# EasyEDA Pro project cubicat_pcb.eprj, board PCB_audio_sdcard
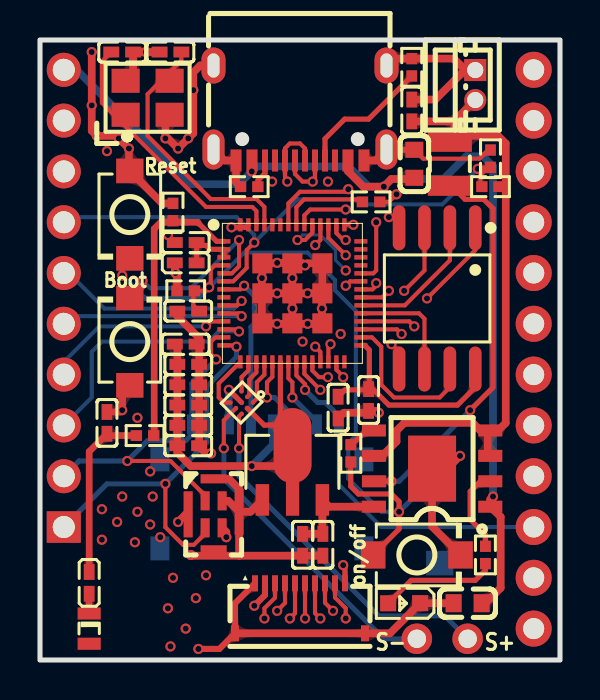
[diagram p13: board, top side]
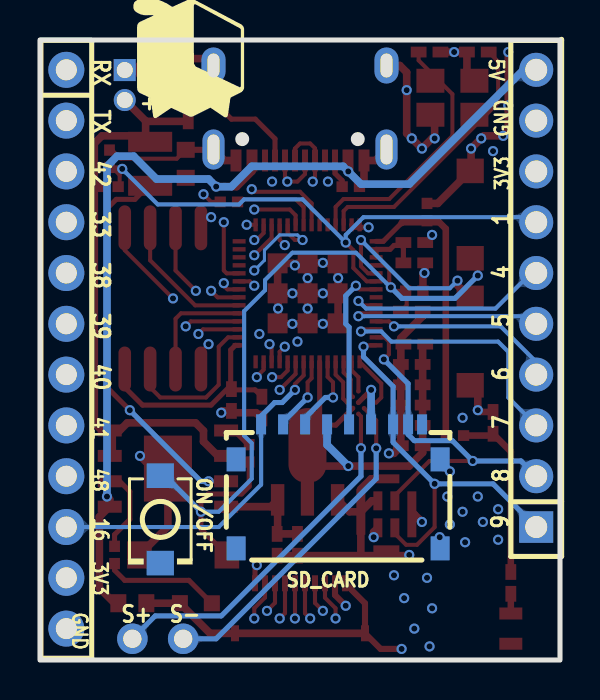
[diagram p14: board, bottom side, seen from below]

Outline 26 x 31 mm; copper layers: Top Layer, GND, PWR, Bottom Layer. Coordinates in mm from the lower left corner of the outline.
Outline path: rectangle 0,31 26,0
Stack: Top Layer 0.035mm 外层铜厚1oz / Dielectric1 0.2104mm 7628 RC49% 8.6mil / GND 0.0152mm 内层铜厚 / Dielectric2 1.065mm 1.1mm H/HOZ 含铜 / PWR 0.0152mm 内层铜厚 / Dielectric3 0.2104mm 7628 RC49% 8.6mil / Bottom Layer 0.035mm 外层铜厚1oz

## Design rules (mm)
net D-: USB-OTG
net D+: USB-OTG
template: 自定义配置
spacing copperThickness1oz (default): track to track 0.102, other pairs 0.152 to 0.3
spacing copperThickness2oz: track to track 0.203, other pairs 0.152 to 0.3
track width copperThickness1oz (default): min 0.127, default 0.254, max 2.54
track width copperThickness2oz: min 0.203, default 0.254, max 2.54
differential pair 90ohm (default): width min 0.203, default 0.203, max 0.229; gap min 0.152, default 0.203
via viaSize (default): diameter min 0.5, default 0.508, max 10; hole min 0.3, default 0.305, max 6.299

## Placement (name value [footprint] x y rotation side)
ANT1  KH-1608-H08  [ANT-SMD_L1.7-W0.9]  2.46 1.57 90 top
BAT1  A1501WV-2P  [CONN-TH_A1501WV-2P]  21.76 28.75 270 top
Boot  TS-1088-AR02016  [SW-SMD_L3.9-W3.0-P4.45]  4.49 15.92 90 top
C4  10uF  [C0402]  18.59 27.48 90 top
C6  10uF  [C0402]  14.14 5.76 270 top
C7  10uF  [C0603]  21.38 2.84 0 top
C8  10uF  [C0603]  18.72 24.81 270 top
C9  10uF  [C0402]  13.13 5.76 270 top
C13  10uF  [C0402]  7.41 11.73 180 top
C14  100nF  [C0402]  7.41 10.71 180 top
C15  1uF  [C0402]  7.41 17.44 0 top
C16  10uF  [C0402]  7.41 13.76 180 top
C17  1uF  [C0402]  7.28 15.79 180 top
C18  100nF  [C0402]  7.28 20.87 0 top
C20  15pF  [C0402]  4.11 30.4 0 top
C21  15pF  [C0402]  6.52 30.4 0 top
C22  1uF  [C0402]  7.41 12.75 180 top
C23  100nF  [C0402]  16.43 13 90 top
C24  1uF  [C0402]  14.91 12.62 90 top
C25  1.5pF  [C0402]  3.35 11.86 270 top
C30  10uF  [C0402]  7.41 14.78 180 top
ESP32S3R8  -  [esp32s3R8]  12.62 18.33 0 top
FPC2  HC-FPC-05-09-10RLTAG  [FPC-SMD_10P-P0.50_HC-FPC-05-09-10RLTAG]  13 2.58 180 top
L1  2.2uH  [IND-SMD_L2.5-W2.0_MHCHL2520]  20.49 24.81 90 top
L2  2nH  [L0402]  7.28 19.86 0 top
L3  5.6nH  [L0402]  2.46 3.86 90 top
LED1  19-213/Y2C-CQ2R2L/3T(CY)  [LED0603-RD-YELLOW]  18.21 2.84 180 top
MIC1  LMD4030T261-OA1  [MIC-SMD_8P-L4.0-W3.0]  8.68 7.28 0 top
NOREF  -  [Pad_e32]  18.84 1.06 0 top
NOREF#2  -  [Pad_e34]  21.38 1.06 0 top
on/off  TS-1088-AR02016  [SW-SMD_L3.9-W3.0-P4.45]  18.84 5.25 0 top
ON/OFF  TS-1088-AR02016  [SW-SMD_L3.9-W3.0-P4.45]  19.99 7.03 270 bottom
Q1  AMS1117-3.3  [SOT-89_L4.5-W2.5-P1.50-LS4.2-BR]  12.62 9.36 270 top
R5  200Ω  [R0402]  22.27 5.25 90 top
R7  10kΩ  [R0402]  7.28 18.46 180 top
R9  5.1kΩ  [R0402]  10.46 23.67 0 top
R10  5.1kΩ  [R0402]  18.59 29.64 90 top
R11  10kΩ  [R0402]  15.54 10.33 270 top
R14  0Ω  [R0402]  5.25 11.22 0 top
R15  0Ω  [R0402]  6.65 22.4 270 top
R20  51kΩ  [R0402]  22.53 23.67 0 top
R22  470Ω  [R0402]  16.56 22.91 0 top
R24  15kΩ  [R0402]  22.53 25.06 270 top
Reset  TS-1088-AR02016  [SW-SMD_L3.9-W3.0-P4.45]  4.49 22.27 270 top
SD_CARD  TF-018  [TF-SMD_TF-018]  11.09 8.68 0 bottom
U6  IP5305T  [ESOP-8_L4.9-W3.9-P1.27-LS6.0-BL-EP]  19.6 9.57 90 top
U25  MAX98357AEWL+T  [WLP-9_L1.4-W1.3-P0.40-R3-C3-BR]  10.08 12.87 45 top
U32  W25Q128JVSIQ  [SOIC-8_L5.3-W5.3-P1.27-LS8.0-BL]  19.86 18.08 180 top
U34  PM254-1-12-Z-8.5  [HDR-TH_12P-P2.54-V-F]  24.68 15.54 270 bottom
U35  PM254-1-10-Z-8.5  [hdr-th_10p-p2.54-v-f]  1.19 18.08 90 bottom
USB1  TYPE-C 16PIN 2MD(073)  [USB-C-SMD_TYPE-C-6PIN-2MD-073]  13 27.35 180 top
X1  40MHz  [osc-smd_4p-l3.2-w2.5-bl_sit8008bi]  5.38 28.11 0 top

## Footprints (pads in the part's own frame, mm; a bottom-side part is the same pattern mirrored in y, then rotated)
ANT-SMD_L1.7-W0.9
  rect 0.6x1.15 smd: 1(-0.756,0) 2(0.756,0)
C0402
  rect 0.79x0.54 smd: 1(-0.545,0) 2(0.545,0)
C0603
  rect 0.8x0.9 smd: 1(-0.7,0) 2(0.7,0)
CONN-TH_A1501WV-2P
  rect 1.1x1.1 hole 0.8: 1(-0.75,0)
  round 1.1 hole 0.8: 2(0.75,0)
ESOP-8_L4.9-W3.9-P1.27-LS6.0-BL-EP
  rect 0.6x1.2 smd: 1(-1.905,-2.909) 2(-0.635,-2.909) 3(0.635,-2.909) 4(1.905,-2.909) 5(1.905,2.909) 6(0.635,2.909) 7(-0.635,2.909) 8(-1.905,2.909)
  rect 3.3x2.4 smd: 9(0,0)
esp32s3R8
  rect 0.65x0.22 smd: 1(-3.425,2.6) 2(-3.425,2.2) 3(-3.425,1.8) 4(-3.425,1.4) 5(-3.425,1) 6(-3.425,0.6) 7(-3.425,0.2) 8(-3.425,-0.2) 9(-3.425,-0.6) 10(-3.425,-1) 11(-3.425,-1.4) 12(-3.425,-1.8) 13(-3.425,-2.2) 14(-3.425,-2.6) 29(3.425,-2.6) 30(3.425,-2.2) 31(3.425,-1.8) 32(3.425,-1.4) 33(3.425,-1) 34(3.425,-0.6) 35(3.425,-0.2) 36(3.425,0.2) 37(3.425,0.6) 38(3.425,1) 39(3.425,1.4) 40(3.425,1.8) 41(3.425,2.2) 42(3.425,2.6)
  rect 0.22x0.65 smd: 15(-2.6,-3.425) 16(-2.2,-3.425) 17(-1.8,-3.425) 18(-1.4,-3.425) 19(-1,-3.425) 20(-0.6,-3.425) 21(-0.2,-3.425) 22(0.2,-3.425) 23(0.6,-3.425) 24(1,-3.425) 25(1.4,-3.425) 26(1.8,-3.425) 27(2.2,-3.425) 28(2.6,-3.425) 43(2.6,3.425) 44(2.2,3.425) 45(1.8,3.425) 46(1.4,3.425) 47(1,3.425) 48(0.6,3.425) 49(0.2,3.425) 50(-0.2,3.425) 51(-0.6,3.425) 52(-1,3.425) 53(-1.4,3.425) 54(-1.8,3.425) 55(-2.2,3.425) 56(-2.6,3.425)
  rect 1x1 smd: 57(-1.5,1.5) 57(-1.5,0) 57(-1.5,-1.5) 57(0,1.5) 57(0,0) 57(0,-1.5) 57(1.5,1.5) 57(1.5,0) 57(1.5,-1.5)
FPC-SMD_10P-P0.50_HC-FPC-05-09-10RLTAG
  rect 0.3x0.8 smd: 1(2.25,-1.25) 2(1.75,-1.25) 3(1.25,-1.25) 4(0.75,-1.25) 5(0.25,-1.25) 6(-0.25,-1.25) 7(-0.75,-1.25) 8(-1.25,-1.25) 9(-1.75,-1.25) 10(-2.25,-1.25)
  rect 0.4x0.8 smd: 11(-3.25,1.25) 12(3.25,1.25)
hdr-th_10p-p2.54-v-f
  rect 1.575x1.7 hole 1.1: 1(-11.43,0)
  round 1.7 hole 1.1: 2(-8.89,0) 3(-6.35,0) 4(-3.81,0) 5(-1.27,0) 6(1.27,0) 7(3.81,0) 8(6.35,0) 9(8.89,0) 10(11.43,0)
HDR-TH_12P-P2.54-V-F
  round 1.8 hole 1.05: 1(-13.97,0) 2(-11.43,0) 3(-8.89,0) 4(-6.35,0) 5(-3.81,0) 6(-1.27,0) 7(1.27,0) 8(3.81,0) 9(6.35,0) 10(8.89,0) 11(11.43,0) 12(13.97,0)
IND-SMD_L2.5-W2.0_MHCHL2520
  rect 1x2.2 smd: 1(-1.1,0) 2(1.1,0)
L0402
  rect 0.79x0.54 smd: 1(-0.545,0) 2(0.545,0)
LED0603-RD-YELLOW
  rect 0.8x0.8 smd: 1(-0.799,-0.004) 2(0.799,0.004)
MIC-SMD_8P-L4.0-W3.0
  rect 0.45x0.95 smd: 1(-0.425,0.675) 2(-0.425,-0.675) 3(0.425,-0.675) 4(0.425,0.675)
  rect 0.45x2.3 smd: 5(1.275,0.127) 7(-1.275,0)
  rect 1.3x0.45 smd: 6(0,-1.775) 8(0,1.775)
osc-smd_4p-l3.2-w2.5-bl_sit8008bi
  rect 1.4x1.2 smd: 1(-1.1,-0.85) 2(1.1,-0.85) 3(1.1,0.85) 4(-1.1,0.85)
Pad_e32
  round 1.524 hole 0.914: 1(0,0)
Pad_e34
  round 1.524 hole 0.914: 2(0,0)
R0402
  rect 0.566x0.54 smd: 1(-0.433,0) 2(0.433,0)
SOIC-8_L5.3-W5.3-P1.27-LS8.0-BL
  oval 0.63x2.25 smd: 1(-1.905,-3.53) 2(-0.635,-3.53) 3(0.635,-3.53) 4(1.905,-3.53) 5(1.905,3.53) 6(0.635,3.53) 7(-0.635,3.53) 8(-1.905,3.53)
SOT-89_L4.5-W2.5-P1.50-LS4.2-BR
  rect 1.575x0.672 smd: 1(1.356,-1.5) 3(1.356,1.5)
  custom 5.377x1.9 smd: 2(-1.356,0.009)
SW-SMD_L3.9-W3.0-P4.45
  rect 1.23x1.36 smd: 1(-2.185,0) 2(2.185,0)
TF-SMD_TF-018
  rect 0.5x1 smd: 1(3.85,-3.1) 2(2.75,-3.1) 3(1.65,-3.1) 4(0.55,-3.1) 5(-0.55,-3.1) 6(-1.65,-3.1) 7(-2.75,-3.1) 8(-3.5,-3.1) 9(-4.2,-3.1)
  rect 0.95x1.2 smd: 10(-5.1,-1.35) 10(-5.1,3.1) 10(5.1,-1.35) 10(5.1,3.1)
USB-C-SMD_TYPE-C-6PIN-2MD-073
  rect 0.55x1.1 smd: 1(-3.2,2.375) 2(-2.4,2.375) 11(2.4,2.375) 12(3.2,2.375)
  rect 0.3x1.1 smd: 3(-1.75,2.375) 4(-1.25,2.375) 5(-0.75,2.375) 6(-0.25,2.375) 7(0.25,2.375) 8(0.75,2.375) 9(1.25,2.375) 10(1.75,2.375)
  oval 1.1x2 hole 0.6x1.5: 13(-4.325,1.825) 14(4.325,1.825)
  oval 1.2x1.8 hole 0.6x1.2: 13(-4.325,-2.375) 14(4.325,-2.375)
WLP-9_L1.4-W1.3-P0.40-R3-C3-BR
  round 0.23 smd: A1(0.4,-0.4) A2(0,-0.4) A3(-0.4,-0.4) B1(0.4,0) B2(0,0) B3(-0.4,0) C1(0.4,0.4) C2(0,0.4) C3(-0.4,0.4)

## Nets
As in the schematic, except:
VOUT+: NOREF#2.2 U25.A3
VOUT-: NOREF.1 U25.B3

Pads without a net: ANT1 1; ESP32S3R8 8 28 39 40 41 42 51 52; SD_CARD 9; USB1 3 9

## Via types
v1: diameter 0.508, hole 0.305, Top Layer to Bottom Layer, 116 vias

## Routing (per net, layer and track width the routed paths; a pad name or vN(x,y) marks a point on that pad's centre or on a via; arc(x,y) is an arc through that point)
GND: length 109.9
  Top Layer w0.203: 22.4,25.5 21.97,25.06 19.16,25.06 C8.1
  Top Layer w0.254: v1(9.44,13.51) U25.B2
  Top Layer w0.305: v1(7.92,0.55) 8.97,0.55 FPC2.12 9.75,2.83 FPC2.1 ; C8.1 17.34,25.51 USB1.13
  Top Layer w0.33: v1(4.11,12.49) 4.02,12.4 C25.1
  Top Layer w0.381: v1(21,10.2) 20.37,9.57 U6.9 19.6,6.67 on/off.2 ; 11.09,18.33 11.09,16.86 ESP32S3R8.57 11.83,16.83 v1(11.86,16.81) v1(13.38,16.81) 14.09,16.81 ; 11.09,18.33 v1(11.86,18.33) ESP32S3R8.57 ; 11.09,18.33 v1(11.09,19.09) 11.12,19.12 ESP32S3R8.57 11.83,19.83 v1(11.86,19.86) 12.59,19.86 ESP32S3R8.57 ; Boot.1 4.11,13.35 v1(4.11,12.49) ; ESP32S3R8.57 13.15,19.83 v1(13.25,19.73) 13.36,19.83 ESP32S3R8.57 ESP32S3R8.57 ; ESP32S3R8.57 v1(12.62,19.09) ESP32S3R8.57 ; MIC1.5 10.53,7.41 11.12,8 ; MIC1.5 9.41,7.96 MIC1.4 ; MIC1.5 9.96,8.55 9.45,9.06 MIC1.8 ; MIC1.5 9.96,5.22 9.97,5.22 ; ESP32S3R8.57 v1(13.38,18.33) ESP32S3R8.57 ; ESP32S3R8.57 v1(12.62,17.57) ESP32S3R8.57 ; 14.09,16.81 v1(14.09,17.58) 14.09,18.31 ESP32S3R8.57 ; 14.09,16.81 ESP32S3R8.57 ; USB1.13 16.78,24.97 USB1.1 ; BAT1.1 21.27,29.5 ; 21.27,29.5 20.69,30.07 R10.2 17.62,30.07 17.32,29.77 USB1.13 ; 21.27,29.5 21.24,29.5 19.77,28.02 C4.2 ; 4.18,28.99 4.66,29.47 C20.2 v1(5.29,30.4) C21.1 ; 9.97,5.22 C9.2 C6.2 ; 9.97,5.22 7.58,5.22 v1(7.54,5.25) ; C23.1 16.85,12.45 v1(16.94,12.36) ; C24.1 15.2,12.36 16.43,12.36 ; X1.2 6.27,27.05 v1(6.27,26.08) 6.4,26.08 v1(6.9,25.57) v1(7.41,26.08) 7.67,26.33 v1(7.67,28.49) 7.67,29.38 8.01,29.72 USB1.14 ; USB1.14 9.22,24.97 USB1.12 9.8,23.89 R9.1 ; R15.1 6.11,22.83 4.45,24.49 v1(4.45,25.57) v1(3.94,26.08) 3.81,26.21 v1(2.84,26.21) 2.59,26.46 v1(2.59,27.73) v1(2.59,30.4) ; v1(6.9,6.9) 7.28,7.28 7.41,7.28 ; C15.1 6.87,17.19 7.96,16.1 C30.1 C16.1 C22.1 C13.1 7.96,10.68 8.3,10.33 v1(8.56,10.33) ; FPC2.12 FPC2.11 17.5,1.33 LED1.1 19.01,2.84 C7.1
  Bottom Layer w0.381: 6,10.03 6,9.92 v1(5.51,9.43) ; 9.44,13.51 SD_CARD.6
  vias: v1(3.09,7.54) v1(3.09,6.01) v1(3.35,25.44) v1(3.86,6.9) v1(4.11,8.17) v1(4.75,5.89) v1(4.87,12.11) v1(4.87,7.41) v1(5.51,6.78) v1(5.63,8.17) v1(6.01,6.14) v1(6.4,21.25) v1(6.4,2.58) v1(6.52,0.68) v1(6.65,4.11) v1(7.28,1.57) v1(7.79,3.09) v1(8.3,4.24) v1(11.6,23.92) v1(13.13,15.92) v1(14.4,23.92) v1(15.03,16.3) v1(17.44,22.14)
VBUS_5V: length 53.1
  Top Layer w0.381: 18.84,24.11 18.78,24.05 17.57,24.05 v1(17.19,23.67) 16.17,23.67 15.4,24.44 USB1.2 ; C7.2 22.27,2.84 23.03,3.6 23.03,7.16 22.53,7.67 ; USB1.11 10.6,24.44 v1(10.59,24.43) ; U6.1 22.51,8.03 v1(22.65,8.17)
  Bottom Layer w0.381: U35.10 1.82,29.51 7.54,23.79 9.95,23.79 v1(10.59,24.43) 10.84,24.68 15.41,24.68 16.43,23.67 v1(17.19,23.67) 17.57,24.05 20.17,24.05 21.32,25.19 22.14,25.19 22.65,24.68 v1(22.65,8.17)
VCC_3V3: length 32.2
  Top Layer w0.203: v1(13.76,20.75) 14.02,21 ESP32S3R8.46
  Top Layer w0.254: v1(9.57,21.64) 10.3,21.64 ESP32S3R8.55 ; ESP32S3R8.20 12.02,11.71 ; 10.36,12.59 11.21,11.74 11.98,11.74
  Top Layer w0.305: FPC2.2 11.25,3.25 v1(10.71,2.71)
  Top Layer w0.381: 6.74,19.73 6.74,19.39 v1(6.78,19.35) 6.85,19.27 6.85,18.71 ; 9.11,6.61 9.32,6.4 v1(9.32,6.14) ; 6.87,15.79 C30.2 C16.2 C22.2 C13.2 C14.2 6.87,10.37 7.54,9.7 v1(10.59,9.7) 11.99,9.7 13.01,10.72 11.98,11.74
  PWR w0.254: 12.62,16.81 11.09,18.33 13.51,20.75 v1(13.76,20.75)
  Bottom Layer w0.381: v1(10.59,9.7) 11.65,10.75 SD_CARD.4
VCC_5V: length 5.4
  Top Layer w0.381: C9.1 C6.1 14.12,6.33 14.12,8 14.46,7.67 U6.8
VDD_SPI: length 11
  Top Layer w0.254: U32.8 21.76,13.63 20.87,12.75 17.44,12.75 16.47,13.72 16.47,15.5 16.24,15.73 ESP32S3R8.29 ; 16.52,13.51 15.25,13.51 C24.2
BAT: length 30.2
  Top Layer w0.381: 22.39,11.47 22.91,11.47 23.29,11.86 23.29,25.83 22.91,26.21 20.72,26.21 20.72,26.95 ; 22.39,11.47 22.39,10.2 ; 22.39,11.47 22.02,11.47 21.64,11.86 18.22,11.86 17.83,11.46 17.83,10.92 17.11,10.2 U6.6 ; 20.72,26.95 20.7,26.93 C4.1 ; 20.72,26.95 BAT1.2
BOOT: length 9.3
  Top Layer w0.203: ESP32S3R8.5 9.59,19.33 9.95,19.69 v1(9.95,21)
  Top Layer w0.381: v1(5.13,18.97) 5.13,18.74 Boot.2
  Bottom Layer w0.203: v1(9.95,21) 7.54,18.59 5.51,18.59 v1(5.13,18.97)
D+: length 15
  Top Layer w0.203: v1(14.52,15.79) 14.42,15.69 ESP32S3R8.26 ; v1(12.37,23.92) 12.25,24.04 USB1.8 12.25,25.58 12.49,25.83 13,25.83 13.25,25.57 13.25,24.98 USB1.6
  PWR w0.203: v1(14.52,15.79) 15.29,15.79 15.54,16.05 15.54,17.13 14.38,18.29 14.38,22.36 12.82,23.92 v1(12.37,23.92)
D-: length 15.3
  Top Layer w0.203: ESP32S3R8.25 14.02,15.41 v1(13.76,15.67) ; USB1.7 12.75,24.3 13.13,23.92 v1(13.63,23.92) 13.75,24.04 USB1.5
  PWR w0.203: v1(13.76,15.67) 14.14,15.28 15.41,15.28 15.92,15.79 15.92,17.32 14.78,18.46 14.78,22.52 13.63,23.67 v1(13.63,23.92)
DAC_BCK: length 1.6
  Top Layer w0.203: ESP32S3R8.16 10.42,14.48 10.08,14.14 U25.C1
DAC_DIN: length 1.9
  Top Layer w0.203: U25.B1 10.46,13.26 10.46,14.02 10.82,14.37 ESP32S3R8.17
DAC_SD_MODE: length 2.3
  Top Layer w0.203: ESP32S3R8.18 11.22,14.27 10.84,13.89 10.84,13.07 U25.A1
DAC_WS: length 2.9
  Top Layer w0.203: 9.51,12.87 9.19,12.87 8.94,13.13 8.94,13.83 ESP32S3R8.15
GPIO1: length 27.8
  Top Layer w0.203: R20.1 22.02,23.74 22.02,24.25 22.4,24.63 21.97,24.63 v1(21.89,24.56) ; v1(10.71,20.87) 10.33,20.49 10.33,19.6 9.66,18.93 ESP32S3R8.6
  Bottom Layer w0.203: v1(21.89,24.56) 20.11,22.78 16.05,22.78 15.79,23.03 12.87,23.03 v1(10.71,20.87) 10.71,21.25 9.82,22.14 1.44,22.14 U35.7
GPIO4: length 29.8
  Top Layer w0.203: ESP32S3R8.9 9.86,17.73 v1(10.08,17.95) ; FPC2.6 13.25,2.08 v1(13.25,2.08)
  PWR w0.203: v1(13.25,2.08) 13.25,10.46 10.84,12.87 10.84,13.38 11.09,13.63 11.09,16.94 v1(10.08,17.95)
  Bottom Layer w0.203: v1(10.08,17.95) 9.7,17.57 3.22,17.57 1.32,19.48
GPIO5: length 28.4
  Top Layer w0.203: FPC2.5 12.75,2.33 v1(12.49,2.08) ; ESP32S3R8.10 9.94,17.33 v1(10.08,17.19)
  PWR w0.203: v1(12.49,2.08) 12.75,2.33 12.75,10.2 10.33,12.62 10.33,13.55 10.71,13.93 10.71,16.56 v1(10.08,17.19)
  Bottom Layer w0.203: U35.5 1.44,17.06 ; v1(10.08,17.19) 1.44,17.19
GPIO6: length 27.5
  Top Layer w0.203: ESP32S3R8.11 8.55,16.93 v1(8.3,16.68) ; v1(11.22,2.08) 11.22,2.58 11.75,3.11 FPC2.3
  PWR w0.203: v1(11.22,2.08) 11.22,2.58 11.48,2.84 11.48,9.95 8.3,13.13 v1(8.3,16.68)
  Bottom Layer w0.203: v1(8.3,16.68) 2.97,16.68 1.19,14.9 U35.4
GPIO7: length 29.5
  Top Layer w0.203: FPC2.4 12.25,2.85 v1(11.86,2.46) ; v1(9.95,16.43) 9.85,16.53 ESP32S3R8.12
  PWR w0.203: v1(9.95,16.43) 10.33,16.05 10.33,14.27 9.95,13.89 9.95,12.24 12.11,10.08 12.11,2.71 v1(11.86,2.46)
  Bottom Layer w0.203: 1.32,11.86 2.59,13.13 2.59,15.41 3.09,15.92 8.43,15.92 8.94,16.43 v1(9.95,16.43)
GPIO17: length 15.2
  Top Layer w0.203: ESP32S3R8.23 13.22,14.3 v1(14.02,13.51) ; v1(14.02,2.08) 13.75,2.34 FPC2.7
  PWR w0.203: v1(14.02,2.08) 13.76,2.33 13.76,13.25 v1(14.02,13.51)
GPIO18: length 15.1
  Top Layer w0.203: v1(14.4,14.14) 13.95,14.14 13.62,14.47 ESP32S3R8.24 ; FPC2.8 14.25,2.86 v1(14.65,2.46)
  PWR w0.203: v1(14.4,14.14) 14.65,13.89 14.65,13.13 14.19,12.67 14.19,2.92 v1(14.65,2.46)
GPIO21: length 15.4
  Top Layer w0.203: FPC2.9 14.75,3.12 15.29,2.58 v1(15.29,2.08) ; v1(15.16,14.14) 15.16,14.18 14.82,14.52 ESP32S3R8.27
  PWR w0.203: v1(15.16,14.14) 15.16,12.75 14.65,12.24 14.65,3.6 15.29,2.97 v1(15.29,2.08)
GPIO33: length 11.3
  Top Layer w0.203: v1(16.81,21.89) 16.81,19.48 16.67,19.33 ESP32S3R8.38
  PWR w0.203: v1(16.81,21.89) 17.06,21.64 24.43,21.64 U34.4
GPIO38: length 10.5
  Top Layer w0.203: ESP32S3R8.43 15.22,21.76 v1(15.67,21.76)
  PWR w0.203: U34.5 22.78,21.25 16.18,21.25 v1(15.67,21.76)
GPIO39: length 13
  Top Layer w0.203: v1(15.29,21) 15.17,21 14.82,21.35 ESP32S3R8.44
  PWR w0.203: v1(15.29,21) 15.54,20.75 22.27,20.75 23.41,19.6 23.41,18.08 U34.6
GPIO40: length 15.5
  Top Layer w0.203: ESP32S3R8.45 14.42,21.11 v1(15.29,20.24)
  PWR w0.203: U34.7 23.03,15.92 23.03,18.84 21.64,20.24 v1(15.29,20.24)
GPIO41: length 20.4
  Top Layer w0.203: v1(12.87,21) 13.25,21 13.62,21.36 ESP32S3R8.47
  PWR w0.203: U34.8 24.68,12.49 22.53,14.65 22.53,18.33 21.13,19.73 15.54,19.73 v1(15.29,19.48) 15.16,19.48
  Bottom Layer w0.152: v1(15.29,19.48) 14.78,19.98 14.78,20.49 14.02,21.25 13.13,21.25 v1(12.87,21)
GPIO42: length 12.9
  Top Layer w0.203: v1(15.29,22.52) 13.51,22.52 13.22,22.23 ESP32S3R8.48
  PWR w0.152: v1(15.29,22.52) 15.54,22.78 23.03,22.78 U34.3
GPIO47: length 16.8
  Top Layer w0.203: v1(15.29,18.71) 15.5,18.93 ESP32S3R8.37
  Top Layer w0.254: FPC2.10 15.25,4.65 v1(15.16,4.74)
  PWR w0.203: v1(15.29,18.71) 16.43,17.57 16.43,13 15.16,11.73 v1(15.16,4.74)
GPIO48: length 16.6
  Top Layer w0.203: v1(16.81,18.84) 16.81,18.71 16.63,18.53 ESP32S3R8.36
  PWR w0.203: v1(16.81,18.84) 17.06,19.09 20.87,19.09 22.02,17.95 22.02,11.86 U34.9
RESET: length 41
  Top Layer w0.203: 9.19,19.73 8.74,19.73 8.54,19.53 8.54,18.71 v1(8.46,18.63) 8.28,18.46 R7.1 7.67,18.41 7.67,17.73 C15.2
  Top Layer w0.254: 15.54,9.9 15.54,8.68 15.92,8.3 17.57,8.3 17.95,7.92 v1(17.95,7.41) 17.95,6.55 on/off.1 ; Reset.2 4.11,19.7 v1(4.11,19.22)
  Bottom Layer w0.203: v1(17.95,7.41) 17.06,7.41 15.41,9.06 15.41,10.84 15.79,11.22 15.79,17.44 14.75,18.49 14.75,19 13.38,20.36 10.21,20.36 8.47,18.63 v1(8.46,18.63)
  Bottom Layer w0.254: ON/OFF.1 19.76,9.22 v1(17.95,7.41) ; v1(8.46,18.63) 7.9,18.08 5.25,18.08 v1(4.11,19.22)
RXD: length 15.9
  Top Layer w0.203: 12.42,22.14 12.42,22.83 13,23.41 15.29,23.41 v1(15.41,23.54) 15.41,23.67
  PWR w0.203: 15.41,23.41 16.18,24.17 19.35,24.17 U34.1
SD_CLK: length 8.3
  Top Layer w0.203: ESP32S3R8.7 10.03,18.53 v1(10.21,18.71)
  Bottom Layer w0.254: SD_CARD.5 10.54,16.64 10.71,16.81 10.71,18.21 v1(10.21,18.71)
SD_CMD: length 4
  Top Layer w0.203: ESP32S3R8.19 11.62,14.16 11.35,13.89 v1(11.35,13.13)
  Bottom Layer w0.254: v1(11.35,13.13) 11.73,13.13 12.75,12.11 SD_CARD.3
SD_DATA0: length 20
  Top Layer w0.203: v1(6.27,8.81) 6.27,6.64 7.15,5.76 7.7,5.76 8.26,6.32 8.26,6.61 ; v1(9.82,15.67) 9.76,15.73 ESP32S3R8.14
  Bottom Layer w0.254: v1(9.82,15.67) 9.82,15.16 8.34,13.68 SD_CARD.7 8.34,10.88 v1(6.27,8.81) 3.35,8.81 U35.1
SD_DATA1: length 18.1
  Top Layer w0.203: MIC1.1 8.26,8.22 6.53,9.95 v1(4.36,9.95) ; v1(8.81,15.03) 8.56,15.28 8.56,15.92 8.77,16.13 ESP32S3R8.13
  Bottom Layer w0.254: U35.2 1.95,9.95 v1(4.36,9.95) 5.38,10.97 7.28,10.97 7.59,11.28 SD_CARD.8 7.59,13.82 v1(8.81,15.03)
SD_DATA2: length 17.9
  Top Layer w0.203: v1(13.25,13.51) 13.25,13.79 12.82,14.23 ESP32S3R8.22
  Bottom Layer w0.203: U34.10 17.06,6.65 14.94,8.77 SD_CARD.1
  Bottom Layer w0.254: v1(13.25,13.51) 13.89,12.87 14.27,12.87 14.94,12.2 SD_CARD.1
SD_DATA3: length 3.7
  Top Layer w0.203: ESP32S3R8.21 12.42,14.09 12.62,13.89 v1(12.62,13.13)
  Bottom Layer w0.254: SD_CARD.2 13.84,11.9 v1(12.62,13.13)
SPICLK: length 5.8
  Top Layer w0.203: U32.6 19.22,17.06 18.95,17.34 16.05,17.34 ESP32S3R8.33
SPICS0: length 9
  Top Layer w0.203: ESP32S3R8.32 18.46,16.93 v1(18.72,16.68) ; U32.1 21.76,20.49 v1(19.35,18.08)
  PWR w0.203: v1(18.72,16.68) 18.72,17.44 v1(19.35,18.08)
SPID: length 5.7
  Top Layer w0.203: ESP32S3R8.35 17.12,18.13 v1(17.44,18.46) ; U32.5 17.95,15.41 v1(17.57,15.79)
  PWR w0.203: v1(17.44,18.46) 17.57,18.33 v1(17.57,15.79)
SPIHD: length 8
  Top Layer w0.203: 20.62,14.55 20.62,13.76 19.99,13.13 17.7,13.13 17.06,13.76 17.06,15.67 16.6,16.13 ESP32S3R8.30
SPIQ: length 7
  Top Layer w0.203: ESP32S3R8.34 18.24,17.73 20.49,19.98 U32.2
SPIWP: length 7.9
  Top Layer w0.203: v1(18.21,18.46) 19.22,19.48 U32.3 ; ESP32S3R8.31 17.85,16.53 v1(18.08,16.3)
  PWR w0.203: v1(18.08,16.3) 18.21,16.43 v1(18.21,18.46)
TXD: length 10.3
  Top Layer w0.203: v1(17.83,23.29) 17.44,22.91 R22.2
  PWR w0.203: U34.2 23.44,25.73 23.44,24.08 22.65,23.29 v1(17.83,23.29)
VOUT+: length 18
  Top Layer w0.203: U25.A3 9.95,12.18 v1(9.95,10.59)
  Bottom Layer w0.254: NOREF#2.2 20.24,2.2 16.94,2.2 9.95,9.19 v1(9.95,10.59)
VOUT-: length 16.7
  Top Layer w0.203: v1(9.19,10.59) 9.19,11.98 9.8,12.59
  Bottom Layer w0.254: v1(9.19,10.59) 9.19,9.06 17.19,1.06 NOREF.1
$1N4090: length 6.7
  Top Layer w0.254: 18.59,29.2 16.43,27.04 15.23,27.04 14.25,26.06 USB1.4
$1N4091: length 1.5
  Top Layer w0.254: R9.2 10.89,23.97 11.25,24.33 USB1.10
$1N4114: length 13.1
  Top Layer w0.203: ESP32S3R8.53 11.22,22.65 10.82,23.05 8.54,23.05 5.38,26.21 5.38,28.29 7.07,29.98 C21.2
$1N4115: length 13.4
  Top Layer w0.203: 3.56,30.4 3.09,29.93 3.09,27.86 8.3,22.65 10.62,22.65 10.82,22.45 ESP32S3R8.54
$1N4126: length 2.7
  Top Layer w0.254: L2.2 7.83,20.62 7.94,20.73 8.3,20.73 8.5,20.53 ESP32S3R8.2 ESP32S3R8.3
$1N4130: length 1
  Top Layer w0.33: L3.1 ANT1.2
$1N4132: length 8.5
  Top Layer w0.33: L3.2 2.46,10.42 C25.2 3.44,11.22 4.57,11.22
$1N4134: length 14.4
  Top Layer w0.254: 7.92,21.87 7.92,21.85 8.84,20.93 ESP32S3R8.1
  Top Layer w0.33: R14.2 5.71,11.25 5.71,21.56 6.04,21.89 7.88,21.89 7.92,21.85
$1N4203: length 4.1
  Top Layer w0.203: 16.25,23.03 13.21,23.03 12.82,22.64 12.82,22.14
$1N53278: length 19.4
  Top Layer w0.254: 20.66,23.62 21.25,23.03 22.19,23.03 22.65,22.57 22.65,13.63 v1(21.51,12.49) ; v1(17.57,8.94) 16.57,8.94
  Bottom Layer w0.254: v1(21.51,12.49) 17.95,8.94 v1(17.57,8.94)
$1N53280: length 6
  Top Layer w0.254: LED1.2 18.55,3.98 21.76,3.98 22.27,4.49 22.27,4.82
  Top Layer w0.381: LED1.2 17.28,2.84
$1N53281: length 4.3
  Top Layer w0.254: 22.51,8.94 22.02,8.94 21.51,8.43 21.51,7.03 22.27,6.27 R5.2
$1N53284: length 1.5
  Top Layer w0.254: U6.5 16.3,11.47 15.54,10.71

## Copper pours and planes (outline as drawn; the poured copper is in the pictures)
GND on Bottom Layer: -2.75,33.45 27.86,33.45 27.86,-1.22 -2.75,-1.22
GND on GND: -3.13,33.95 29.13,33.95 29.13,-1.35 -3.13,-1.35
VCC_3V3 on PWR: -2.49,32.94 27.99,32.94 27.99,-1.48 -2.49,-1.48

Small or netless copper shapes (teardrops, artwork), in the pictures only: 282 on Top Layer, 58 on Bottom Layer, 45 on PWR

## Text on the board
Bottom Silkscreen Layer: 5V | 16 | 41 | 48 | 3V3 | GND | S- | S+ | - | + | RX | TX | 42 | 33 | 38 | 39 | 40 | 1 | 4 | 5 | 6 | 7 | 8 | 9
Top Silkscreen Layer: S- | S+
